# Altium schematic sheet ProbadorDeCables_Accesorios_A_SZCNT_8.SchDoc
size A4
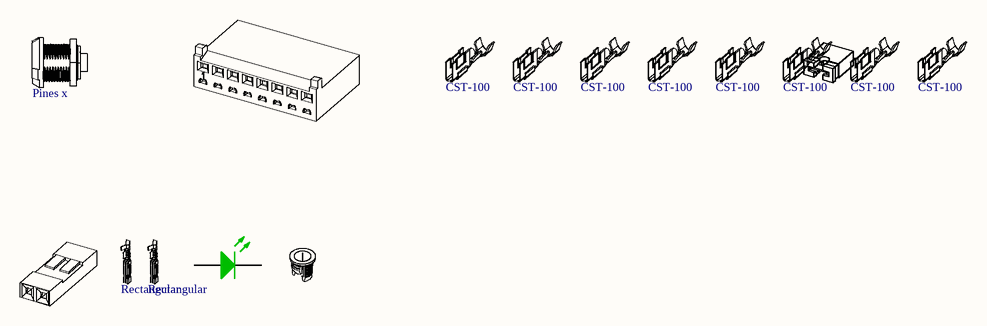
[diagram p0: ProbadorDeCables_Accesorios_A_SZCNT_8.SchDoc]

## Parts
BOM_A29  Pines: Pines x  [BOM_SZCNT_Hembra]  (hidden comment: SZCNT_0x_Hembra)  (mechanical)
BOM_A29__1  CST-100-8  [BOM_CST-100-8]  (value not drawn)  (mechanical)
BOM_A29__2  ParaHousing: CST-100  [BOM_sock_CST_1375819-1]  (hidden comment: sock_CST_1375819-1)  (mechanical)
BOM_A29__3  ParaHousing: CST-100  [BOM_sock_CST_1375819-1]  (hidden comment: sock_CST_1375819-1)  (mechanical)
BOM_A29__4  ParaHousing: CST-100  [BOM_sock_CST_1375819-1]  (hidden comment: sock_CST_1375819-1)  (mechanical)
BOM_A29__5  ParaHousing: CST-100  [BOM_sock_CST_1375819-1]  (hidden comment: sock_CST_1375819-1)  (mechanical)
BOM_A29__6  ParaHousing: CST-100  [BOM_sock_CST_1375819-1]  (hidden comment: sock_CST_1375819-1)  (mechanical)
BOM_A29__7  ParaHousing: CST-100  [BOM_sock_CST_1375819-1]  (hidden comment: sock_CST_1375819-1)  (mechanical)
BOM_A29__8  ParaHousing: CST-100  [BOM_sock_CST_1375819-1]  (hidden comment: sock_CST_1375819-1)  (mechanical)
BOM_A29__9  ParaHousing: CST-100  [BOM_sock_CST_1375819-1]  (hidden comment: sock_CST_1375819-1)  (mechanical)
BOM_A34  Rectangular_100-2  [BOM_M20-1060200]  (value not drawn)  (mechanical)
BOM_A34__1  ParaHousing: Rectangular  [BOM_sock_Rect_M20-1180046]  (hidden comment: sock_M20-1060200)  (mechanical)
BOM_A34__2  ParaHousing: Rectangular  [BOM_sock_Rect_M20-1180046]  (hidden comment: sock_M20-1060200)  (mechanical)
BOM_A34__3  LED_5mm_Verde  [BOM_LED-Verde-5mm]  (value not drawn)  (mechanical)
BOM_A34__4  Porta Leds 5mm  [BOM_Porta-LED-5mm]  (value not drawn)  (mechanical)

## Nets

Not connected (* = marked no-connect by the designer): BOM_A34__3 1(A) 2(K)

## Library data of the parts
BOM_A29 = SZCNT_0x_Hembra: Conector SZCNT x vías hembra para gabinete; Cod.DigiKey: Se compra a SZCNT; Cod.Fabricante: *; ComponentLink1Description: Manufacturer Link; ComponentLink1URL: *; DIGIKEYx100: *; Fabricante: SZCNT; DIGIKEYx50: *
BOM_A29__1 = CST-100-8: CONN RCPT HSNG 8POS CST-100 II; Cod.Fabricante: 1375820-8; Fabricante: TE Connectivity AMP Connectors; Cod.DigiKey: A99618-ND; ComponentLink1Description: Manufacturer Link; ComponentLink1URL: https://www.te.com/commerce/DocumentDelivery/DDEController?Action=srchrtrv&DocNm=1375820&DocType=Customer+Drawing&DocLang=English; DIGIKEYx50: 0.31600; DIGIKEYx100: 0.30290
BOM_A29__2-BOM_A29__9 = sock_CST_1375819-1: CONN SOCKET 22-26AWG CRIMP TIN; Fabricante: TE Connectivity AMP Connectors; Cod.DigiKey: A100453CT-ND; Cod.Fabricante: 1375819-1; ComponentLink1Description: Manufacturer Link; ComponentLink1URL: https://www.te.com/commerce/DocumentDelivery/DDEController?Action=srchrtrv&DocNm=1375819&DocType=Customer+Drawing&DocLang=English; DIGIKEYx100: 0.04210; DIGIKEYx50: 0.03960
BOM_A34 = Rectangular_100-2: CONN RCPT HSG 2POS 2.54MM; Cod.Fabricante: M20-1060200; Fabricante: Harwin Inc.; Cod.DigiKey: 952-2227-ND; ComponentLink1Description: Manufacturer Link; ComponentLink1URL: https://cdn.harwin.com/pdfs/C001XX_M20_Series_Connectors.pdf; DIGIKEYx50: 0.09600; DIGIKEYx100: *
BOM_A34__1 BOM_A34__2 = sock_M20-1060200: CONN SOCKET 22-30AWG CRIMP TIN; Cod.Fabricante: M20-1180046; Fabricante: Harwin Inc.; Cod.DigiKey: 952-2159-ND; ComponentLink1Description: Manufacturer Link; ComponentLink1URL: https://cdn.harwin.com/pdfs/C001XX_M20_Series_Connectors.pdf; DIGIKEYx100: *; DIGIKEYx50: 0.08700
BOM_A34__3 = LED_5mm_Verde: LED GREEN DIFFUSED 5MM T/H; Cod.Fabricante: TLHG6400; Fabricante: Vishay Semiconductor Opto Division; Cod.DigiKey: 751-1114-ND; ComponentLink1Description: Manufacturer Link; ComponentLink1URL: https://www.vishay.com/docs/83219/tlhg640.pdf; DIGIKEYx100: 0.18740
BOM_A34__4 = Porta Leds 5mm: HOLDER LED PANEL 5MM BLACK NYLON; Cod.Fabricante: SSH-LX5091; Fabricante: Lumex Opto/Components Inc.; Cod.DigiKey: 67-1332-ND; ComponentLink1Description: Manufacturer Link; ComponentLink1URL: http://www.lumex.com/specs/SSH-LX5091.pdf; DIGIKEYx50: *; DIGIKEYx100: 0.07800